# Altium schematic sheet TopSheet.SchDoc (continued)
## Parts (continued)
R10  value 10k  Tolerance: 1%  Package / Case: 0603  [0603_R]  (hidden comment: RC0603FR-1310KP)
R13  value 10k  Tolerance: 1%  Package / Case: 0603  [0603_R]  (hidden comment: RC0603FR-1310KP)
R14  value 10k  Tolerance: 1%  Package / Case: 0603  [0603_R]  (hidden comment: RC0603FR-1310KP)
R15  value 10k  Tolerance: 1%  Package / Case: 0603  [0603_R]  (hidden comment: RC0603FR-1310KP)
R16  value 10k  Tolerance: 1%  Package / Case: 0603  [0603_R]  (hidden comment: RC0603FR-1310KP)
R17  value 220  [0603_R]  (hidden comment: RC0603FR-07220RL)
R18  value 1k  Package / Case: 0603  Tolerance: 1%  [0603_R]  (hidden comment: RC0603FR-101KL)
R19  value 1k  Package / Case: 0603  Tolerance: 1%  [0603_R]  (hidden comment: RC0603FR-101KL)
R20  value 100k  Package / Case: 0603  Tolerance: 1%  [0603_R]  (hidden comment: RC0603FR-07100KP)
R21  value 5.1k  Package / Case: 0603  Tolerance: 1%  [0603_R]  (hidden comment: RC0603FR-135K1L)
R22  value 5.1k  Package / Case: 0603  Tolerance: 1%  [0603_R]  (hidden comment: RC0603FR-135K1L)
R23  value 43.2k  Package / Case: 0603  Tolerance: 1%  [0603_R]  (hidden comment: RC0603FR-1043K2L)
R24  value 0  [RESC1608X55X25ML10T15]  (hidden comment: Resistor 0R +/- 5% 0603 100 mW)
U3  Sensor  [LGA-28]
U4  STM32H563VGT6  [LQFP-100]
U5  TMP235A4DCKR  [FP-DCK0005A-MFG]
U6  FT232RNL-REEL  [FP-FT232RNL-REEL-MFG]
U7  LMR33610BDDAR  [FP-DDA0008J-IPC_C]
Y1  830053798  [WE-XTAL_CFPX-104]
Y2  830009678  [WE-XTAL_CFPX-217]
Y3  830009678  [WE-XTAL_CFPX-217]

## Blocks framed on the sheet
BNO055: C8-C12 R3-R7 U3 Y3
TMP235x: C13 C14 U5
PINS 101-200: J3
UART Connector. GPS: J2 J4 R17 R24
USBC Connector  & USBC-UART Bridge: C33-C38 D2-D7 F1 J9 J10 L1 R18 R19 R21 R22 U6
POWER SUPPLY (m.c. 1A): C39-C42 C47-C49 L2 R20 R23 U7

## Sub-sheets
U_Antenna1 = Antenna.SchDoc: UART_TX_ANT (in), UART_RTS_ANT (in), TIM_1 (in), UART_CTS_ANT (out), UART_RX_ANT (out)
U_Antenna2 = Antenna.SchDoc: UART_TX_ANT (in), UART_RTS_ANT (in), TIM_1 (in), UART_CTS_ANT (out), UART_RX_ANT (out)
U_CAN_Transceiver1 = CAN_Transceiver.SchDoc: FDCAN_RX (out), FDCAN_TX (in)
U_CAN_Transceiver2 = CAN_Transceiver.SchDoc: FDCAN_RX (out), FDCAN_TX (in)

## Nets
+3V3: C8.2 C9.2 C13.2 C22.2 C23.2 C24.2 C25.2 C26.2 C27.2 C28.2 C29.2 C30.2 C31.2 C32.2 C42.2 C47.2 C48.2 J6.3 J7.3 J8.3 L2.2 P1.3 R3.2 R4.2 R5.2 R6.2 R8.2 R13.2 R14.2 R15.2 R16.2 R20.2 U3.3(VDD) U3.28(VDDIO) U4.6(VBAT) U4.11(VDD) U4.21(VREF+) U4.22(VDDA) U4.28(VDD) U4.50(VDD) U4.73(VDDUSB) U4.75(VDD) U4.100(VDD) U5.4(VDD)
+5V: C35.2 C36.2 C40.2 C41.2 D3.1 D4.1 D5.2(A) D6.2(A) J2.77 J2.79 J2.81 J2.83 J2.85 J2.87 U6.20(VCC) U7.2(VIN) U7.3(EN)
GND: C8.1 C9.1 C10.1 C11.2 C12.2 C13.1 C14.1 C15.2 C16.2 C17.2 C18.2 C19.1 C20.1 C21.1 C22.1 C23.1 C24.1 C25.1 C26.1 C27.1 C28.1 C29.1 C30.1 C31.1 C32.1 C33.2(N) C34.1 C35.1 C36.1 C37.1 C38.1 C40.1 C41.1 C42.1 C47.1 C49.1 D2.1 D7.2(GND) J2.1 J2.2 J2.7 J2.8 J2.13 J2.14 J2.22 J2.23 J2.32 J2.33 J2.42 J2.43 J2.52 J2.53 J2.59 J2.60 J2.65 J2.66 J2.71 J2.74 J2.98 J3.7 J3.8 J3.13 J3.14 J3.19 J3.20 J3.25 J3.26 J3.31 J3.32 J3.37 J3.38 J3.44 J3.50 J3.55 J3.56 J3.61 J3.62 J3.67 J3.68 J3.73 J3.74 J3.79 J3.80 J3.85 J3.86 J3.91 J3.92 J3.97 J3.98 J4.3 J6.4 J7.4 J8.4 J9.1 J10.1(GND) J10.2(GND) J10.3(GND) J10.4(GND) J10.A1(GND) J10.A12(GND) J10.B1(GND) J10.B12(GND) P1.5 P1.7 P1.11 R7.1 R10.1 R21.2 R22.2 R23.1 U3.2(GND) U3.5(PS1) U3.6(PS0) U3.18(COM2) U3.25(GNDIO) U4.10(VSS) U4.19(VSSA) U4.20(VREF-) U4.27(VSS) U4.49(VSS) U4.74(VSS) U4.99(VSS) U5.2(GND) U6.7(GND) U6.18(GND) U6.21(GND) U6.25(AGND) U6.26(TEST) U7.1(PGND) U7.9(THERMAL_PAD) Y1.2(GND_&_Lid) Y1.4(GND_&_Lid)
3V3_REF: J2.84 J2.86 R24.1
3V3_Resistored: J2.78 R24.2
5V_FUSED: C33.1(P) D2.2 D3.2 F1.2
ADC1_INP9: C14.2 U4.35(PB0) U5.3(VOUT)
BNO_CAP: C10.2 U3.9(CAP)
BNO_COM3: R7.2 U3.17(COM3)
BNO_XTAL_IN: C11.1 U3.27(XIN32) Y3.1(OSC1)
BNO_XTAL_OUT: C12.1 U3.26(XOUT32) Y3.2(OSC2)
BRIDGE_3V3: C34.2 U6.4(VCCIO) U6.17(3V3OUT)
CAN1_RX: U4.81(PD0) ; sheet U_CAN_Transceiver2/FDCAN_RX
CAN1_TX: U4.82(PD1) ; sheet U_CAN_Transceiver2/FDCAN_TX
CAN2_RX: U4.56(PD9) ; sheet U_CAN_Transceiver1/FDCAN_RX
CAN2_TX: U4.52(PB13) ; sheet U_CAN_Transceiver1/FDCAN_TX
Global_En: J2.99 U4.30(PA5)
I2C2_SCL: R5.1 U3.19(COM1) U4.47(PB10)
I2C2_SDA: R4.1 U3.20(COM0) U4.51(PB12)
JTCK_SWCLK: P1.6 U4.76(PA14)
JTDI: P1.10 U4.77(PA15)
JTDO: P1.8 U4.89(PB3)
JTMS_SWDIO: P1.4 U4.72(PA13)
LMR_BOOT: C39.1 U7.7(BOOT)
LMR_FB: C48.1 R20.1 R23.2 U7.5(FB)
LMR_SW: C39.2 L2.1 U7.8(SW)
LMR_VCC: C49.2 U7.6(VCC)
MCU_32IN: C15.1 U4.8(PC14-OSC32_IN) Y2.1(OSC1)
MCU_32OUT: C17.1 U4.9(PC15-OSC32_OUT) Y2.2(OSC2)
MCU_BOOT0: R10.2 U4.94(BOOT0)
MCU_CRISTALL: C18.1 R9.1 Y1.3(Crystal)
MCU_NRST: C21.2 R8.1 U4.14(NRST)
MCU_VCAP1: C20.2 U4.48(VCAP)
MCU_VCAP2: C19.2 U4.98(VCAP)
MCU_XTAL_IN: C16.1 U4.12(PH0-OSC_IN) Y1.1(Crystal)
MCU_XTAL_OUT: R9.2 U4.13(PH1-OSC_OUT)
NTJRST: P1.12 U4.90(PB4)
RPI_92: J2.92 R17.1
Run_PG: R17.2 U4.29(PA4)
RX5: J2.28 J4.2
RXLED#: R19.1 U6.22(CBUS1)
RXLED#_R: D6.1(C) R19.2
SAFESHUTDOWN: J2.24 U4.31(PA6)
SCL_1: J7.2 R13.1 U4.92(PB6)
SCL_4: J8.2 R15.1 U4.95(PB8)
SCREW_C_5V: F1.1 J9.2
SDA_1: J7.1 R14.1 U4.93(PB7)
SDA_4: J8.1 R16.1 U4.60(PD13)
SPI4-6_CE0_N: J2.49 U4.3(PE4)
SPI4-6_MISO: J2.26 U4.4(PE5)
SPI4-6_MOSI: J2.27 U4.5(PE6)
SPI4-6_SCLK: J2.25 U4.1(PE2)
TIM1_CH1_GPIO_2: J5.2 U4.40(PE9)
TIM1_CH2: U4.42(PE11) ; sheet U_Antenna1/TIM_1
TIM1_CH3_GPIO_3: J5.3 U4.44(PE13)
TIM1_CH4_GPIO_4: J5.4 U4.45(PE14)
TIM3_CH4_GPIO_1: J5.1 U4.36(PB1)
TIM4_CH1: R6.1 U3.11(RESET) U4.59(PD12)
TIM4_CH3: R3.1 U3.4(BOOT_LOAD_PIN) U4.61(PD14)
TIM4_CH4: U3.14(INT) U4.62(PD15)
TIM12_CH1_GPIO_6: J5.6 U4.53(PB14)
TIM12_CH2_GPIO_5: J5.5 U4.54(PB15)
TIM17_CH1: U4.96(PB9) ; sheet U_Antenna2/TIM_1
TX5: J2.31 J4.1
TXLED#: R18.1 U6.23(CBUS0)
TXLED#_R: D5.1(C) R18.2
UART_1_CTS: U4.70(PA11) ; sheet U_Antenna1/UART_CTS_ANT
UART_1_RTS: U4.71(PA12) ; sheet U_Antenna1/UART_RTS_ANT
UART_1_RX: U4.69(PA10) ; sheet U_Antenna1/UART_RX_ANT
UART_1_TX: U4.68(PA9) ; sheet U_Antenna1/UART_TX_ANT
UART_2_CTS: U4.23(PA0) ; sheet U_Antenna2/UART_CTS_ANT
UART_2_RTS: U4.24(PA1) ; sheet U_Antenna2/UART_RTS_ANT
UART_2_RX: U4.26(PA3) ; sheet U_Antenna2/UART_RX_ANT
UART_2_TX: U4.25(PA2) ; sheet U_Antenna2/UART_TX_ANT
UART_3_RX: J6.2 U4.79(PC11)
UART_3_TX: J6.1 U4.78(PC10)
USART2_CTS: U4.84(PD3) U6.3(~{RTS})
USART2_RTS: U4.85(PD4) U6.11(~{CTS})
USART2_RX: U4.87(PD6) U6.1(TXD)
USART2_TX: U4.86(PD5) U6.5(RXD)
USART6_RX_TX0: J2.55 U4.64(PC7)
USART6_TX_RX0: J2.51 U4.63(PC6)
USB_5V: C37.2 D7.5(VDD) J10.A4(VBUS) J10.A9(VBUS) J10.B4(VBUS) J10.B9(VBUS) L1.1
USB_5V_SCH: C38.2 D4.2 L1.2
USB_N: D7.3(I/O_2) D7.4(I/O_2) J10.A7(Dn1) J10.B7(Dn2) U6.16(USBDM)
USB_P: D7.1(I/O_1) D7.6(I/O_1) J10.A6(Dp1) J10.B6(Dp2) U6.15(USBDP)
USBC_C_CC1: J10.A5(CC1) R21.1
USBC_C_CC2: J10.B5(CC2) R22.1

Not connected (* = marked no-connect by the designer): J2 3* 4* 5* 6* 9* 10* 11* 12* 15* 16* 17* 18* 19* 20* 21* 29* 30* 34* 35* 36* 37* 38* 39* 40* 41* 44* 45* 46* 47* 48* 50 54* 56* 57* 58* 61* 62* 63* 64* 67* 68* 69* 70* 72* 73* 75* 76* 80* 82* 88* 89* 90* 91* 93* 94* 95* 96* 97* 100*; J3 1* 2* 3* 4* 5* 6* 9* 10* 11* 12* 15* 16* 17* 18* 21* 22* 23* 24* 27* 28* 29* 30* 33* 34* 35* 36* 39* 40* 41* 42* 43* 45* 46* 47* 48* 49* 51* 52* 53* 54* 57* 58* 59* 60* 63* 64* 65* 66* 69* 70* 71* 72* 75* 76* 77* 78* 81* 82* 83* 84* 87* 88* 89* 90* 93* 94* 95* 96* 99* 100*; J10 A8(SBU1)* B8(SBU2)*; P1 1* 2* 9* 13* 14*; U3 1(NC)* 7(SWDIO)* 8(SWCLK)* 10(BLIND)* 12(NC)* 13(NC)* 21(NC)* 22(NC)* 23(NC)* 24(NC)*; U4 2(PE3)* 7(PC13)* 15(PC0)* 16(PC1)* 17(PC2)* 18(PC3)* 32(PA7)* 33(PC4)* 34(PC5)* 37(PB2)* 38(PE7)* 39(PE8)* 41(PE10)* 43(PE12)* 46(PE15)* 55(PD8)* 57(PD10)* 58(PD11)* 65(PC8)* 66(PC9)* 67(PA8)* 80(PC12)* 83(PD2)* 88(PD7)* 91(PB5)* 97(PE0)*; U5 1(NC)* 5(NC)*; U6 2(~{DTR})* 6(~{RI})* 8(NC)* 9(~{DSR})* 10(~{DCD})* 12(CBUS4)* 13(CBUS2)* 14(CBUS3)* 19(~{RESET})* 24(NC)* 27(OSCI)* 28(OSCO)*; U7 4(PG)*

## Layout directives
differential pair: USB_N, USB_P

## Notes on the sheet
- Type of Connection: I2C
  SDA line: This wire sends data to a slave device. Any data sent from one device to another goes through the SDA wire.
  SCL line: It provides the necessary synchronization clock for the data transfer.
- PINS 1-100
- Debug Connector
- GPIO Connectors
- 1.4 A -max current of CM4
- 1*STM32H5 (m.c. 350mA)
- 1*Debug Screw Connector
- I2C Connectors
- 6*GPIO Screw Connectors
- 1*UART Screw Connector
- UART Connector
- Global_EN -Immediate. Run-PG should be 1 for power up. 0 for power down. Safe Shut down is for example for 21. Gpio is: dtoverlay=gpio-shutdown,gpio_pin=21
- 2*I2C Screw Connectors
- 2*CAN Screw Connectors
- Layout: chrome-extension://efaidnbmnnnibpcajpcglclefindmkaj/https://www.we-online.com/components/media/o452288v410%20ANE009a_DE.pdf
- SENSOR BOARD FOR THE DRONE
- HOPPER PROJEKT
- 2A Fuse, Schottky-Diode. 82400102 schematic aendern. Filter vereinfachen
- USBC-UART Bridge (m.c. 24mA)
- USBC Connector
- (in symbol CMP-207835-000005-2) +

## Library data of the parts
C8-C10 C39 = CMP-001-00745-1: CAP CER 0.1UF 16V X7R 0603; Manufacture: KYOCERA AVX; Tolerance: 10%; Product Status: Active; Series: KGM - X7R; Applications: General Purpose; Size / Dimension: 0.063" L x 0.032" W (1.60mm x 0.81mm); Case/Package: Tape & Reel (TR),Cut Tape (CT),Digi-Reel®; Mounting Type: Surface Mount, MLCC; Operating Temperature: -55°C ~ 125°C; Manufacture Part Number: KGM15AR71C104KT; Thickness (Max): 0.035" (0.90mm); Temperature Coefficient: X7R
C11 C12 C15 C17 = CMP-001-00301-1: CAP CER 15PF 16V C0G/NP0 0603; Manufacture: KYOCERA AVX; Temperature Coefficient: C0G, NP0; Tolerance: 10%; Product Status: Active; Applications: General Purpose; Thickness (Max): 0.035" (0.90mm); Series: KGM - C0G; Voltage - Rated: 16V; Mounting Type: Surface Mount, MLCC; Case/Package: Tape & Reel (TR),Cut Tape (CT),Digi-Reel®; Manufacture Part Number: KGM15ACG1C150KT; Operating Temperature: -55°C ~ 125°C; Package / Case: 0603; Size / Dimension: 0.063" L x 0.032" W (1.60mm x 0.81mm)
C13 C21 C23-C32 C34-C36 C47 = CMP-001-00851-1: CAP CER 0.1UF 16V X7R 0603; Manufacture: KYOCERA AVX; Tolerance: 10%; Product Status: Active; Mounting Type: Surface Mount, MLCC; Case/Package: Tape & Reel (TR),Cut Tape (CT),Digi-Reel®; Temperature Coefficient: X7R; Applications: General Purpose; Thickness (Max): 0.035" (0.90mm); Manufacture Part Number: KGM15AR71C104KM; Size / Dimension: 0.063" L x 0.032" W (1.60mm x 0.81mm); Operating Temperature: -55°C ~ 125°C; Series: KGM - X7R
C14 = CMP-001-00329-1: CAP CER 680PF 16V X7R 0603; Manufacture: KYOCERA AVX; Tolerance: 10%; Product Status: Active; Series: KGM - X7R; Thickness (Max): 0.035" (0.90mm); Manufacture Part Number: KGM15AR71C681KT; Applications: General Purpose; Temperature Coefficient: X7R; Mounting Type: Surface Mount, MLCC; Operating Temperature: -55°C ~ 125°C; Size / Dimension: 0.063" L x 0.032" W (1.60mm x 0.81mm); Case/Package: Tape & Reel (TR),Cut Tape (CT),Digi-Reel®
C16 C18 = CMP-001-00865-1: CAP CER 22PF 16V C0G/NP0 0603; Manufacture: KYOCERA AVX; Temperature Coefficient: C0G, NP0; Product Status: Active; Tolerance: 10%; Mounting Type: Surface Mount, MLCC; Case/Package: Tape & Reel (TR),Cut Tape (CT),Digi-Reel®; Manufacture Part Number: KGM15ACG1C220KT; Operating Temperature: -55°C ~ 125°C; Size / Dimension: 0.063" L x 0.032" W (1.60mm x 0.81mm); Thickness (Max): 0.035" (0.90mm); Series: KGM - C0G; Applications: General Purpose
C19 C20 C22 = CMP-001-01906-1: CAP CER 2.2UF 16V X5R 0603; Manufacture: KYOCERA AVX; Product Status: Active; Tolerance: 10%; Temperature Coefficient: X5R; Case/Package: Tape & Reel (TR),Cut Tape (CT),Digi-Reel®; Operating Temperature: -55°C ~ 85°C; Thickness (Max): 0.035" (0.90mm); Applications: General Purpose; Mounting Type: Surface Mount, MLCC; Size / Dimension: 0.063" L x 0.031" W (1.60mm x 0.80mm); Series: KGM - X5R; Manufacture Part Number: KGM15AR51C225KT
C33 = CMP-207835-000005-2: CAP ALUM POLY 10UF 20% 10V SMD; NexarPartId: 54202679; Leakage Current: 300µA; Material: Aluminium; Pitch: 4.3mm; Life (Hours): 2000hours; Polarity: Polar; ESR (Equivalent Series Resistance): 45mΩ; Capacitance: 10µF; Ripple Current: 1.2A; Dissipation Factor: 8%; Diameter: 4mm; Packaging: Tape & Reel (TR); Min Operating Temperature: -55°C; REACH SVHC: Unknown; Height - Seated (Max): 5.5118mm; Voltage Rating (DC): 10V; RoHS: Compliant; Length: 5.5mm; Mount: Surface Mount; Height: 5.5mm; Case/Package: Radial; Tolerance: 20%; Voltage Rating: 10V; Max Operating Temperature: 105°C
C37 C38 C40 = CMP-001-01338-1: CAP CER 4.7UF 16V X5R 0603; Manufacture: KYOCERA AVX; Tolerance: 20%; Product Status: Active; Temperature Coefficient: X5R; Series: KGM - X5R; Size / Dimension: 0.063" L x 0.031" W (1.60mm x 0.80mm); Applications: General Purpose; Operating Temperature: -55°C ~ 85°C; Manufacture Part Number: 0603YD475MAT2A; Case/Package: Tape & Reel (TR),Cut Tape (CT),Digi-Reel®; Mounting Type: Surface Mount, MLCC; Thickness (Max): 0.037" (0.95mm)
C41 = CMP-001-00300-1: CAP CER 0.22UF 16V X7R 0603; Manufacture: KYOCERA AVX; Tolerance: 20%; Product Status: Active; Mounting Type: Surface Mount, MLCC; Manufacture Part Number: KGM15BR71C224MT; Applications: General Purpose; Thickness (Max): 0.037" (0.95mm); Case/Package: Tape & Reel (TR),Cut Tape (CT),Digi-Reel®; Series: KGM - X7R; Temperature Coefficient: X7R; Size / Dimension: 0.063" L x 0.032" W (1.60mm x 0.81mm); Operating Temperature: -55°C ~ 125°C
C42 = CMP-001-00833-1: CAP CER 100UF 6.3V X5R 1210; Manufacture: KYOCERA AVX; Product Status: Active; Tolerance: 20%; Mounting Type: Surface Mount, MLCC; Voltage - Rated: 6.3V; Applications: General Purpose; Manufacture Part Number: 12106D107MAT2A; Operating Temperature: -55°C ~ 85°C; Thickness (Max): 0.110" (2.80mm); Temperature Coefficient: X5R; Package / Case: 1210; Series: KGM - X5R; Case/Package: Tape & Reel (TR),Cut Tape (CT),Digi-Reel®; Size / Dimension: 0.126" L x 0.098" W (3.20mm x 2.50mm)
C48 = CMP-001-01272-1: CAP CER 150PF 16V C0G/NP0 0603; Manufacture: KYOCERA AVX; Temperature Coefficient: C0G, NP0; Product Status: Active; Tolerance: 5%; Thickness (Max): 0.035" (0.90mm); Mounting Type: Surface Mount, MLCC; Series: KGM - C0G; Size / Dimension: 0.063" L x 0.032" W (1.60mm x 0.81mm); Manufacture Part Number: KGM15ACG1C151JT; Operating Temperature: -55°C ~ 125°C; Case/Package: Tape & Reel (TR),Cut Tape (CT),Digi-Reel®; Applications: General Purpose
C49 = CMP-001-01077-1: CAP CER 1UF 16V X5R 0603; Manufacture: KYOCERA AVX; Tolerance: 10%; Product Status: Active; Mounting Type: Surface Mount, MLCC; Applications: General Purpose; Thickness (Max): 0.037" (0.95mm); Temperature Coefficient: X5R; Size / Dimension: 0.063" L x 0.031" W (1.60mm x 0.80mm); Manufacture Part Number: 0603YD105KAT4A; Case/Package: Tape & Reel (TR),Cut Tape (CT),Digi-Reel®; Series: KGM - X5R; Operating Temperature: -55°C ~ 85°C
D2 = CMP-03913-71101561-1: 824501500 WE-TVSP Power TVS Diode; Number of Bidirectional Channels: 1; Reverse Standoff Voltage: 5V; Peak Pulse Current: 43.5A; Breakdown Voltage: 6.7V; Leakage Current: 1.6mA; Clamping Voltage: 9.2V; Power Line Protection: No; Polarity: Bidirectional; Peak Pulse Power: 400W; Number of Pins: 2; Mount: Surface Mount; NexarPartId: 71101561; Height: 2.25mm; Max Operating Temperature: 150°C; RoHS: Compliant; Max Breakdown Voltage: 6.7V; Min Breakdown Voltage: 6.7V; REACH SVHC: Unknown; Width: 2.67mm; Min Operating Temperature: -65°C; Packaging: Cut Tape; Length: 4.24mm; Composition: Zener
D3 D4 = PMEG3020EP-QX: Schottky Diode; Supplier 1: Digikey; Supplier Part Number 1: 1727-PMEG3020EP-QXCT-ND
D5 = CMP-2000-05197-2: LED GREEN CLEAR CHIP SMD; Test Current: 20mA; Power Rating: 75mW; Forward Voltage: 2V; Wavelength: 574nm; Number of LEDs: 1; Reverse Voltage: 5V; Dominant Wavelength: 571nm; Lens Style: Diffused; Luminous Intensity: 35mcd; Forward Current: 30mA; Viewing Angle: 130°; Lens Color: Colorless; Width: 0.8mm; Case Code (Imperial): 0603; Case Code (Metric): 1608; Number of Pins: 2; Radiation Hardening: No; Package Quantity: 1; Lead Free: Lead Free; Lens Transparency: Clear; Depth: 0.8mm; Power Dissipation: 75mW; Mount: Surface Mount; Max Operating Temperature: 85°C; Case/Package: 0603; Height: 0.8mm; Illumination Color: Green; Color: Green; Length: 1.6mm; Packaging: Tape and Reel; Number of Elements: 1; Min Operating Temperature: -55°C
D6 = CMP-1674-00011-2: LED RED CLEAR CHIP SMD; Reverse Voltage: 5V; Viewing Angle: 130°; Power Rating: 75mW; Test Current: 20mA; Number of Elements: 1; Lens Color: Colorless; Wavelength: 639nm; Dominant Wavelength: 631nm; Lens Style: Diffused; Forward Current: 30mA; Forward Voltage: 2.4V; Luminous Intensity: 54mcd; Color: Red; Case Code (Imperial): 0603; Lens Transparency: Clear; Lead Free: Lead Free; Package Quantity: 1; Packaging: Tape and Reel; Max Operating Temperature: 85°C; Number of Pins: 2; Height: 0.8mm; Case/Package: 0603; Number of LEDs: 1; Width: 0.8mm; Case Code (Metric): 1608; Depth: 0.8mm; Mount: Surface Mount; Radiation Hardening: No; Length: 1.6mm; Illumination Color: Red; Power Dissipation: 75mW; Min Operating Temperature: -55°C
D7 = CMP-1486-00007-2: NexarPartId: 22862942; Max Reverse Leakage Current: 5A; Test Current: 1mA; Number of Channels: 2; Leakage Current: 5µA; Min Breakdown Voltage: 6V; Working Voltage: 5V; Direction: Unidirectional; Max Surge Current: 6A; Element Configuration: Dual; ESD Protection: Yes; Capacitance: 2pF; Forward Voltage: 800mV; Polarity: Bidirectional; Clamping Voltage: 7.7V; RoHS: Compliant; Number of Bidirectional Channels: 2; Mount: Surface Mount; Number of Pins: 6; Case/Package: SOT-23; Length: 2.9mm; Min Operating Temperature: -55°C; REACH SVHC: Unknown; Max Operating Temperature: 125°C; Max Breakdown Voltage: 6V; Reverse Standoff Voltage: 5V; Width: 2.8mm; Breakdown Voltage: 6V; Height: 1.16mm; Termination: SMD/SMT; Power Line Protection: Yes; Operating Supply Voltage: 6V; Packaging: Digi-Reel®; Peak Pulse Current: 6A
F1 = CMP-00287-21220540-1: ERB-RE2R00V Fuse Chip Fast Acting 2A 32V SMD Solder Pad 0603 1.6 X 0.8 X 0.54mm T/R UL/cUL; Approvals: UL; Resistance: 51mΩ; Body Material: Alumina; Case/Package: 0603; Packaging: Cut Tape; RoHS: Compliant; Width: 800µm; Min Operating Temperature: -40°C; Length: 1.6mm; Mount: Surface Mount; Radiation Hardening: No; Voltage Rating: 32V; Voltage Rating (DC): 32V; REACH SVHC: No SVHC; Case Code (Imperial): 0603; Height: 640µm; Lifecycle Status: Production; Depth: 800µm; Current: 2A; Fuse Current: 2A; Max Operating Temperature: 125°C; Current Rating: 2A; Number of Pins: 2; Lead Free: Lead Free; Case Code (Metric): 1608; Max Voltage Rating (DC): 32V
J2 J3 = CMP-002-00071-1: 100 Position Connector Receptacle, Center Strip Contacts Surface Mount Gold; MF: Hirose; Case/Package: None; MP: DF40C-100DS-0.4V(51); Pins: 100; Component Type: Standard; Value: *; Design Item ID: DF40C-100DS-0.4V(51); Source: DF40C-100DS-0.4V(51).SchLib; SnapEDA_Link: https://www.snapeda.com/parts/DF40C-100DS-0.4V(51)/Hirose/view-part/?ref=snap; Check_prices: https://www.snapeda.com/parts/DF40C-100DS-0.4V(51)/Hirose/view-part/?ref=eda
J4 = CMP-1502-02457-2: NexarPartId: 105950650
J5 = CMP-1502-02460-2: NexarPartId: 105950653
J6-J8 = CMP-1502-02458-2: NexarPartId: 105950651
J9 = CMP-1502-02456-2: NexarPartId: 105950649; Current Rating: 6A; Voltage Rating: 150V; Number of Contacts: 2; Number of Rows: 1; Contact Material: Tin; Height: 8.7mm; Max Operating Temperature: 105°C; Min Operating Temperature: -40°C
J10 = CMP-03329-129995627-1: USB4145-03-0230-C USB Connectors USB-C Rec 3u Vert 16P SMT 2.3mm TH stakes H7.46mm T+R+Cap; Number of Contacts: 16; USB Standard: USB 2.0; Voltage Rating: 48V; Current Rating: 6.25A; Min Operating Temperature: -25°C; Contact Material: Gold, Nickel; Height: 7.66mm; NexarPartId: 129995627; Max Operating Temperature: 85°C
L1 = CMP-0220-00183-1: SMD EMI Suppression Ferrite Bead WE-CBF, Z = 33 Ohm; Impedance: 15 Ohm; PackageReference: SMD-0603; ComponentLink1URL: http://www.we-online.com; ComponentLink2URL: http://www.we-online.de/katalog/media/pdf/742792605.pdf; ComponentLink1Description: Manufacturer Link; DatasheetVersion: Dec-2005; PackageDescription: Chip Inductor, 2-Leads, Body 1.6 x 0.8 mm; ComponentLink2Description: Datasheet; PackageVersion: 2009
L2 = CMP-0227-00438-2: NexarPartId: 22866896; DC Resistance (DCR): 42mΩ; Test Frequency: 10kHz; Max DC Current: 4A; Self Resonant Frequency: 43MHz; Shielding: Unshielded; Resistance: 60mΩ; Inductance Tolerance: 20%; Core Material: Ferrite; Saturation Current: 7.5A; Case/Package: Nonstandard; Packaging: Digi-Reel®; Height - Seated (Max): 4.8514mm; Composition: Wirewound; Current Rating: 4A; Max Operating Temperature: 125°C; RoHS: Compliant; RMS Current (Irms): 4A; Tolerance: 20%; Width: 5.8mm; Lead Free: Lead Free; Termination: SMD/SMT; Ambient Temperature Range High: 85°C; REACH SVHC: Unknown; Length: 5.2mm; Height: 4.5mm; Mount: Surface Mount; Min Operating Temperature: -40°C; Ambient Temperature Range Low: -40°C
P1 = CMP-1502-00949-3: NexarPartId: 32855587; Number of Contacts: 14; Gender: Male; Current Rating: 1A; Contact Resistance: 20mΩ; Connector Type: Male Pin; Row Spacing: 1.27mm; Operating Supply Voltage: 100V; Orientation: Vertical; Mount: Through Hole; RoHS: Compliant; Number of Positions: 14; Contact Mating Length: 3.81mm; REACH SVHC: Unknown; Pitch: 1.27mm; Color: Black; Lead Pitch: 1.27mm; Packaging: Box; Number of Rows: 2; Termination: Solder; Contact Material: Copper; Number of Pins: 14; Contact Plating: Gold
R3-R8 R10 R13-R16 = CMP-009-01763-1: RES 10K OHM 1% 1/10W 0603; Manufacture: YAGEO; Temperature Coefficient: ±100ppm/°C; Power (Watts): 0.1W, 1/10W; Product Status: Active; Manufacture Part Number: RC0603FR-1310KP; Number of Terminations: 0.022" (0.55mm); Features: -; Operating Temperature: -55°C ~ 155°C; Case/Package: Tape & Reel (TR),Cut Tape (CT),Digi-Reel®; Composition: Thick Film; Size / Dimension: 7C1 RoHS w/out Exemption (100% Pb-Free); Series: RC_P; Height - Seated (Max): 0.063" L x 0.031" W (1.60mm x 0.80mm)
R9 R24 = CMP-009-00006-5: Chip Resistor, 0 Ohm, 0.1 W, -55 to 155 degC, 0603 (1608 Metric); Power: 100mW; Voltage Rating: 50V; Max Operating Temperature: 155°C; RoHS Compliant: True; Mounting Technology: SM; Case/Package: 0603; Min Operating Temperature: -55°C; Tolerance: 5%; Pins: 2
R17 = CMP-009-01834-1: RES 220 OHM 1% 1/10W 0603; Manufacture: YAGEO; Temperature Coefficient: ±100ppm/°C; Product Status: Active; Power (Watts): 0.1W, 1/10W; Operating Temperature: -55°C ~ 155°C; Package / Case: 0603; Size / Dimension: 0.063" L x 0.031" W (1.60mm x 0.80mm); Case/Package: Tape & Reel (TR),Cut Tape (CT),Digi-Reel®; Number of Terminations: 2; Composition: Thick Film; Tolerance: 1%; Features: Moisture Resistant; Manufacture Part Number: RC0603FR-07220RL; Height - Seated (Max): 0.022" (0.55mm); Series: RC_L
R18 R19 = CMP-009-03836-1: RES 1K OHM 1% 1/10W 0603; Manufacture: YAGEO; Temperature Coefficient: ±100ppm/°C; Product Status: Active; Power (Watts): 0.1W, 1/10W; Number of Terminations: 2; Height - Seated (Max): 0.022" (0.55mm); Composition: Thick Film; Case/Package: Tape & Reel (TR),Cut Tape (CT),Digi-Reel®; Manufacture Part Number: RC0603FR-101KL; Features: Moisture Resistant; Size / Dimension: 0.063" L x 0.031" W (1.60mm x 0.80mm); Series: RC_L; Operating Temperature: -55°C ~ 155°C
R20 = CMP-009-00863-1: RES 100K OHM 1% 1/10W 0603; Manufacture: YAGEO; Temperature Coefficient: ±100ppm/°C; Power (Watts): 0.1W, 1/10W; Product Status: Active; Features: -; Operating Temperature: -55°C ~ 155°C; Composition: Thick Film; Size / Dimension: 0.063" L x 0.031" W (1.60mm x 0.80mm); Number of Terminations: 2; Series: RC_P; Case/Package: Tape & Reel (TR),Cut Tape (CT),Digi-Reel®; Manufacture Part Number: RC0603FR-07100KP; Height - Seated (Max): 0.022" (0.55mm)
R21 R22 = CMP-009-00181-1: RES 5.1K OHM 1% 1/10W 0603; Manufacture: YAGEO; Product Status: Active; Temperature Coefficient: ±100ppm/°C; Power (Watts): 0.1W, 1/10W; Size / Dimension: 0.063" L x 0.031" W (1.60mm x 0.80mm); Operating Temperature: -55°C ~ 155°C; Height - Seated (Max): 0.022" (0.55mm); Composition: Thick Film; Number of Terminations: 2; Manufacture Part Number: RC0603FR-135K1L; Series: RC_L; Case/Package: Tape & Reel (TR),Cut Tape (CT),Digi-Reel®; Features: -
R23 = CMP-009-00596-1: RES 43.2K OHM 1% 1/10W 0603; Manufacture: YAGEO; Product Status: Active; Temperature Coefficient: ±100ppm/°C; Power (Watts): 0.1W, 1/10W; Height - Seated (Max): 0.022" (0.55mm); Manufacture Part Number: RC0603FR-1043K2L; Size / Dimension: 0.063" L x 0.031" W (1.60mm x 0.80mm); Operating Temperature: -55°C ~ 155°C; Number of Terminations: 2; Case/Package: Tape & Reel (TR),Cut Tape (CT),Digi-Reel®; Features: Moisture Resistant; Composition: Thick Film; Series: RC_L
U3 = BNO055: ComponentLink1Description: New link; Supplier 1: Mouser; Supplier Part Number 1: 262-BNO055
U4 = STM32H563VGT6TR: Parameter 1: *; Parameter 2: *; Supplier 1: Mouser; Supplier Part Number 1: 511-STM32H563VGT6
U5 = CMP-04948-000022-1: SENSOR ANALOG -40C-150C SC70-5; Manufacturer: Texas Instruments; Max Junction Temp: +150°C; Output Current: 500uA; Standoff Height: 0mm; Output Voltage: 100-2000mV; Operating Supply Current: 9-10uA; Min Supply Voltage: 2.3V; Sensor Output: Analog Voltage; Max Supply Voltage: 5.5V; Ambient Temperature Range High: +150°C; Manufacturer Part Number: TMP235A4DCKR; Temperature Range Low: -40°C; Temperature Range High: +150°C; Lead Free: Yes; Mouser Description: ±2.5°C Analog output temperature sensor, with 10mV /°C gain 5-SC70 -40 to 150; Height: 1.1mm; ComponentLink2Description: Datasheet; ComponentLink2URL: https://www.ti.com/lit/ds/symlink/tmp235.pdf; Device Class L1: Sensors; Ambient Temperature Range Low: -40°C; Temperature: -40°C to +150°C; Device Class L2: Temperature and Humidity Sensors; Category: IC; Digikey Description: SENSOR ANALOG -40C-150C SC70-5; Automotive: No; RoHS: TRUE; Device Class L3: unset; Package: DCK0005A; Octopart: https://octopart.com/tmp235a4dckr-texas+instruments-88184449
U6 = CMP-01051-130495957-1: FT232RNL-REEL Integrated Circuit Interface USB-UART; RS-232; 12Mbs; 3, 3v-5.25V; -40+85 deg.C; SMD; SSOP28; Max Supply Voltage: 5.25V; Data Rate: 3Mbps; Nominal Supply Current: 7mA; USB Standard: USB 2.0; Number of Ports: 1; Interface: UART, USB; Min Supply Voltage: 1.8V; Min Operating Temperature: -40°C; Height: 2mm; Max Operating Temperature: 85°C; NexarPartId: 130495957; Ambient Temperature Range High: 85°C
U7 = CMP-04918-000366-1: 36V 1A 1.4MHZ REGULATOR
Y1 = CMP-03913-116855686-1: 830053798 WE-XTAL Quartz Crystal; Frequency: 24MHz; Max Operating Temperature: 85°C; Length: 5mm; Height: 1mm; Min Operating Temperature: -40°C; NexarPartId: 116855686; Width: 3.2mm
Y2 Y3 = CMP-03913-116855621-1: 830009678 WE-XTAL Quartz Crystal; Frequency: 32.768kHz; Length: 3.2mm; NexarPartId: 116855621; Max Operating Temperature: 85°C; Width: 1.5mm; Height: 900µm; Min Operating Temperature: -40°C